# Altium schematic sheet 0 overview.SchDoc
size A4; DocumentNumber: 0; SheetNumber: 2; SheetTotal: 9
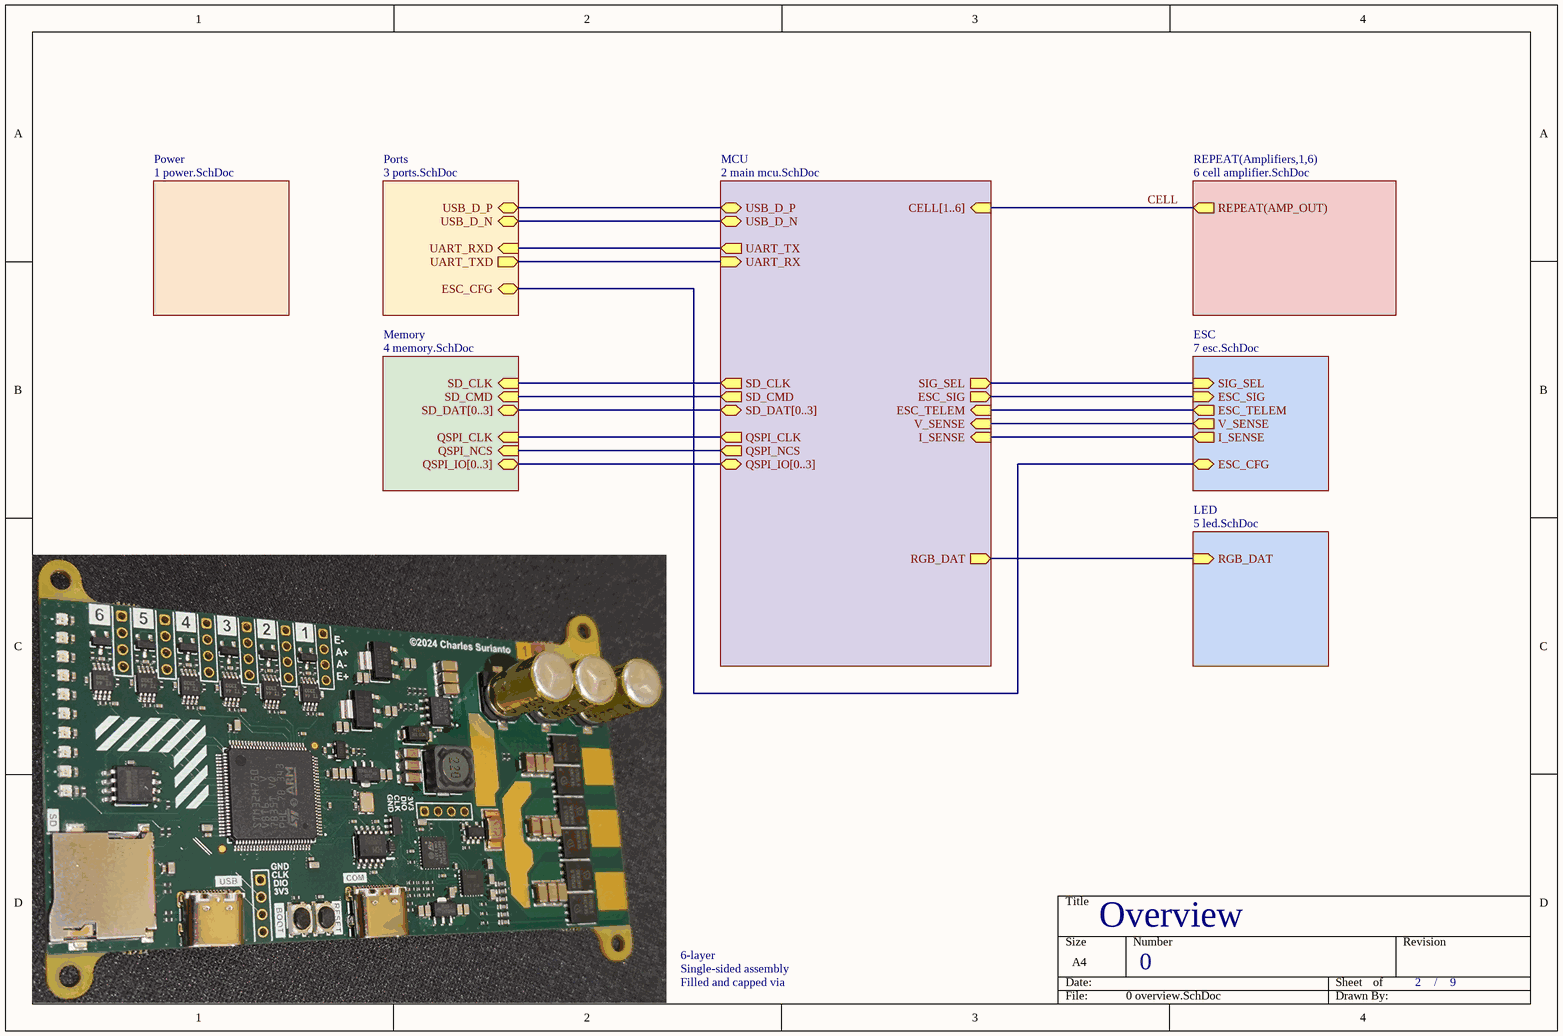
[diagram p0: 0 overview.SchDoc]

## Sub-sheets
ESC = 7 esc.SchDoc: ESC_TELEM (out), V_SENSE (out), I_SENSE (out), ESC_SIG (in), ESC_CFG (bidir), SIG_SEL (in)
LED = 5 led.SchDoc: RGB_DAT (in)
MCU = 2 main mcu.SchDoc: USB_D_P (bidir), USB_D_N (bidir), ESC_SIG (out), SIG_SEL (out), ESC_TELEM (in), UART_RX (in), UART_TX (out), SD_CLK (out), SD_CMD (out), SD_DAT[0..3] (bidir), QSPI_IO[0..3] (bidir), QSPI_CLK (out), QSPI_NCS (out), I_SENSE (in), V_SENSE (in), RGB_DAT (out), CELL[1..6] (in)
Memory = 4 memory.SchDoc: SD_CLK (in), SD_CMD (in), SD_DAT[0..3] (bidir), QSPI_IO[0..3] (bidir), QSPI_CLK (in), QSPI_NCS (in)
Ports = 3 ports.SchDoc: ESC_CFG (bidir), UART_RXD (in), UART_TXD (out), USB_D_P (bidir), USB_D_N (bidir)
Power = 1 power.SchDoc: no entries
REPEAT(Amplifiers,1,6) = 6 cell amplifier.SchDoc: REPEAT(AMP_OUT) (out)

## Nets
CELL: sheet REPEAT(Amplifiers,1,6)/REPEAT(AMP_OUT)
(unnamed): sheet MCU/USB_D_P, sheet Ports/USB_D_P
(unnamed): sheet MCU/USB_D_N, sheet Ports/USB_D_N
(unnamed): sheet MCU/ESC_SIG, sheet ESC/ESC_SIG
(unnamed): sheet MCU/SIG_SEL, sheet ESC/SIG_SEL
(unnamed): sheet MCU/ESC_TELEM, sheet ESC/ESC_TELEM
(unnamed): sheet MCU/UART_RX, sheet Ports/UART_TXD
(unnamed): sheet MCU/UART_TX, sheet Ports/UART_RXD
(unnamed): sheet MCU/SD_CLK, sheet Memory/SD_CLK
(unnamed): sheet MCU/SD_CMD, sheet Memory/SD_CMD
(unnamed): sheet MCU/QSPI_CLK, sheet Memory/QSPI_CLK
(unnamed): sheet MCU/QSPI_NCS, sheet Memory/QSPI_NCS
(unnamed): sheet MCU/I_SENSE, sheet ESC/I_SENSE
(unnamed): sheet MCU/V_SENSE, sheet ESC/V_SENSE
(unnamed): sheet MCU/RGB_DAT, sheet LED/RGB_DAT
(unnamed): sheet Ports/ESC_CFG, sheet ESC/ESC_CFG

## Buses and harness runs
bus sheet MCU/QSPI_IO[0..3] = sheet Memory/QSPI_IO[0..3]
bus sheet MCU/SD_DAT[0..3] = sheet Memory/SD_DAT[0..3]

## Notes on the sheet
- 6-layer
- Single-sided assembly
- Filled and capped via
- Overview
- /